# EasyEDA Pro project PRO_project.eprj, board PCB2
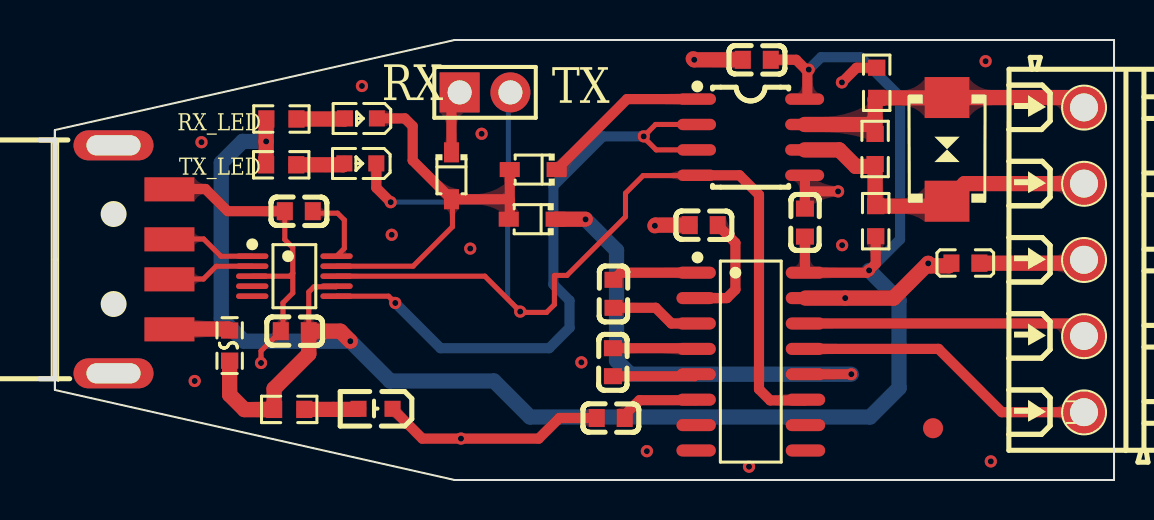
[diagram p15: board, top side]
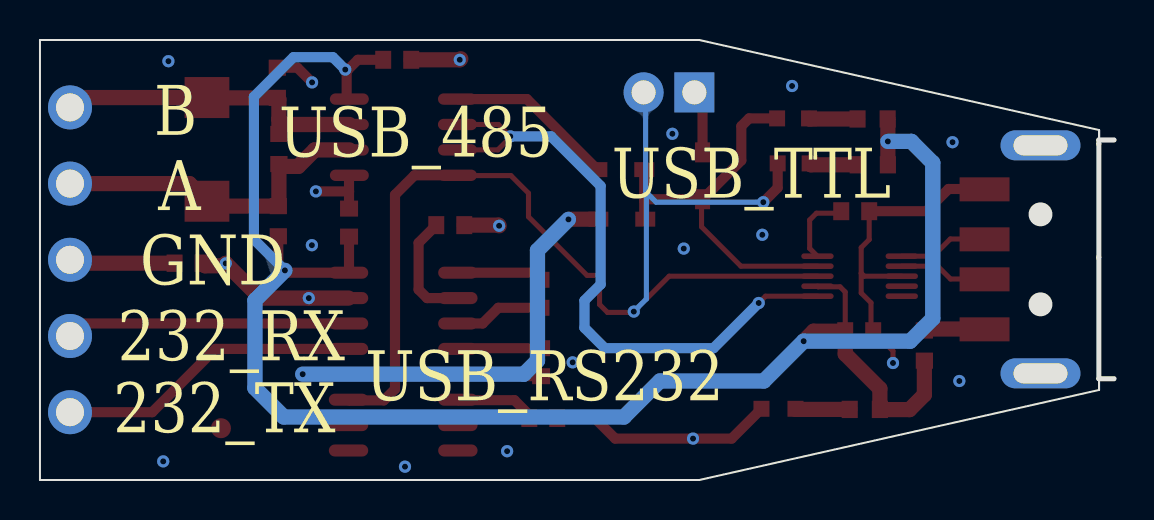
[diagram p16: board, bottom side, seen from below]

Outline 53.75 x 22 mm; copper layers: Top Layer, Bottom Layer. Coordinates in mm from the lower left corner of the outline.
Outline path: 0.75,17.5 0.75,11 0.75,17.5 ; 0.75,17.5 0.75,4.5 ; 0.75,17.5 20.75,22 53.75,22 53.75,0 20.75,0 0.75,4.5 ; 0.75,17.5 0.75,4.5
Stack: Top Layer 0.035mm / Dielectric1 1.51mm FR4 er 4.5 / Bottom Layer 0.035mm

## Design rules (mm)
template: 自定义配置
spacing copperThickness1oz (default): track to track 0.152, other pairs 0.152 to 0.3
spacing copperThickness2oz: track to track 0.203, other pairs 0.152 to 0.3
track width copperThickness1oz (default): min 0.127, default 0.254, max 2.54
track width copperThickness2oz: min 0.203, default 0.254, max 2.54
differential pair differentialPair (default): width min 0.127, default 0.254, max 2.54; gap min 0.152, default 0.152
via viaSize (default): diameter min 0.5, default 0.61, max 10; hole min 0.3, default 0.305, max 6.299

## Placement (name value [footprint] x y rotation side)
C1  100nF  [C0603]  12.95 13.44 180 top
C3  100nF  [C0603]  12.75 7.44 0 top
C4  100nF  [C0603]  38.28 12.87 270 top
C5  100nF  [C0603]  28.7 9.31 90 top
C6  100nF  [C0603]  33.22 12.74 180 top
C7  100nF  [C0603]  35.87 21.01 180 top
C8  100nF  [C0603]  28.67 5.89 90 top
C9  100nF  [C0603]  28.56 3.1 180 top
CN1  WJ124-3.81-5P  [CONN-TH_5P-P3.81_KF124-3.81-5P]  52.25 11.01 90 top
D1  1N5819WS  [SOD-323_L1.8-W1.3-LS2.5-RD]  24.63 13.04 180 top
D2  1N5819WS  [SOD-323_L1.8-W1.3-LS2.5-RD]  24.68 15.52 180 top
D3  1N5819WS  [SOD-323_L1.8-W1.3-LS2.5-RD]  20.59 15.21 270 top
D5  P6SMB6.8CA/TR13  [SMB_L4.6-W3.6-LS5.3-BI]  45.39 16.53 90 top
F1  BSMD0603-050-6V  [F0603]  9.49 6.72 270 top
H1  PZ254V-11-02P  [HDR-TH_2P-P2.54-V-M]  22.27 19.38 0 top
L1  GZ1608D601TF  [L0603]  46.31 10.84 0 top
LED1  KT-0603R  [LED0603-RD]  16.06 18.08 180 top
LED2  KT-0603R  [LED0603-RD]  16.03 15.83 180 top
LED3  KT-0603W  [LED0603-R-RD_WHITE]  16.79 3.56 180 top
MARK1  -  [Mark-Point-1mm]  44.69 2.59 0 top
R1  4.7kΩ  [R0603]  12.08 18.05 180 top
R2  4.7kΩ  [R0603]  12.07 15.76 180 top
R3  4.7kΩ  [R0603]  12.47 3.53 180 top
R4  4.7kΩ  [R0603]  41.87 19.86 90 top
R5  120Ω  [R0603]  41.79 16.55 270 top
R6  4.7kΩ  [R0603]  41.82 12.94 90 top
RS232_1  SP3232EEN-L/TR  [SOIC-16_L9.9-W3.9-P1.27-LS6.0-BL]  35.57 5.92 270 top
U1  CH340X  [MSOP-10_L3.0-W3.0-P0.50-LS5.0-BL]  12.73 10.19 270 top
U2  SP485EEN-L/TR  [SOIC-8_L5.0-W4.0-P1.27-LS6.0-BL]  35.56 17.14 270 top
USB1  U217-041N-4BV81  [USB-A-SMD_U217-041N-4BV81]  5.08 11.03 270 top

## Footprints (pads in the part's own frame, mm; a bottom-side part is the same pattern mirrored in y, then rotated)
C0603
  rect 0.8x0.9 smd: 1(-0.7,0) 2(0.7,0)
CONN-TH_5P-P3.81_KF124-3.81-5P
  round 2.2 hole 1.4: 1(-7.62,0) 2(-3.81,0) 3(0,0) 4(3.81,0) 5(7.62,0)
F0603
  rect 0.806x0.864 smd: 1(-0.753,0) 2(0.753,0)
HDR-TH_2P-P2.54-V-M
  rect 2x2 hole 1.2: 1(-1.27,0)
  round 2 hole 1.2: 2(1.27,0)
L0603
  rect 0.8x0.864 smd: 1(-0.7,0) 2(0.7,0)
LED0603-R-RD_WHITE
  rect 0.8x0.8 smd: 1(0.851,0) 2(-0.851,0)
LED0603-RD
  rect 0.8x0.8 smd: 1(-0.799,0) 2(0.799,0)
Mark-Point-1mm
  round 1 smd: 1(0,0)
MSOP-10_L3.0-W3.0-P0.50-LS5.0-BL
  oval 0.28x1.62 smd: 1(-1,-2.11) 2(-0.5,-2.11) 3(0,-2.11) 4(0.5,-2.11) 5(1,-2.11) 6(1,2.11) 7(0.5,2.11) 8(0,2.11) 9(-0.5,2.11) 10(-1,2.11)
R0603
  rect 0.806x0.864 smd: 1(-0.753,0) 2(0.753,0)
SMB_L4.6-W3.6-LS5.3-BI
  rect 2.047x2.241 smd: 1(-2.591,0) 2(2.591,0)
SOD-323_L1.8-W1.3-LS2.5-RD
  rect 1x0.75 smd: 1(-1.173,0) 2(1.173,0)
SOIC-8_L5.0-W4.0-P1.27-LS6.0-BL
  oval 0.569x1.95 smd: 1(-1.905,-2.705) 2(-0.635,-2.705) 3(0.635,-2.705) 4(1.905,-2.705) 5(1.905,2.705) 6(0.635,2.705) 7(-0.635,2.705) 8(-1.905,2.705)
SOIC-16_L9.9-W3.9-P1.27-LS6.0-BL
  oval 0.602x1.971 smd: 1(-4.445,-2.736) 2(-3.175,-2.736) 3(-1.905,-2.736) 4(-0.635,-2.736) 5(0.635,-2.736) 6(1.905,-2.736) 7(3.175,-2.736) 8(4.445,-2.736) 9(4.445,2.736) 10(3.175,2.736) 11(1.905,2.736) 12(0.635,2.736) 13(-0.635,2.736) 14(-1.905,2.736) 15(-3.175,2.736) 16(-4.445,2.736)
USB-A-SMD_U217-041N-4BV81
  rect 1.2x2.5 smd: 1(3.5,1.4) 2(1,1.4) 3(-1,1.4) 4(-3.5,1.4)
  oval 1.5x4 hole 1x2.7: 5(-5.7,-1.4) 6(5.7,-1.4)

## Nets
As in the schematic, except:
SS: U1.6 U2.2 U2.3

Pads without a net: MARK1 1; RS232_1 7 8 9 10; U1 4 5; USB1 5

## Via types
v1: diameter 0.61, hole 0.305, Top Layer to Bottom Layer, 30 vias

## Routing (per net, layer and track width the routed paths; a pad name or vN(x,y) marks a point on that pad's centre or on a via; arc(x,y) is an arc through that point)
+5V: length 96
  Top Layer w0.254: U1.7 14.81,9.66 13.71,9.66 13.45,9.4 C3.2
  Top Layer w0.508: 38.33,20.52 37.84,21.01 C7.1 ; 38.33,20.52 38.4,20.45 38.4,19.18 U2.8 ; 38.33,20.52 v1(38.47,20.52) ; R6.1 41.82,10.81 v1(41.49,10.48) 41.38,10.37 RS232_1.16 38.28,10.39 C4.2
  Top Layer w0.762: R1.2 11.32,18.04 v1(11.32,16.93) R2.2 ; v1(15.53,6.94) 15.03,7.44 C3.2 13.45,6.3 11.72,4.57 R3.2 11.71,3.52 10.23,3.52 9.49,4.26 F1.2
  Bottom Layer w0.508: v1(41.49,10.48) 43.04,12.03 43.04,19.16 41.06,21.14 39.09,21.14 v1(38.47,20.52)
  Bottom Layer w0.762: v1(41.49,10.48) 42.99,8.98 42.99,4.6 41.54,3.15 24.52,3.15 22.72,4.95 17.52,4.95 v1(15.53,6.94) 10.2,6.94 9.07,8.07 9.07,15.86 10.14,16.93 v1(11.32,16.93)
GND: length 45.9
  Top Layer w0.254: 12.65,10.34 12.65,9.35 12.16,8.86 12.16,7.55 C3.1 11.06,6.45 v1(11.06,5.85) ; 12.65,10.34 12.65,11.62 12.25,12.02 C1.2 ; 12.65,10.34 12.5,10.19 U1.3
  Top Layer w0.508: v1(40.13,19.88) 40.86,20.61 R4.2 ; C1.2 9.39,13.44 8.28,14.55 6.5,14.55 ; 38.28,14.43 38.28,15.22 U2.5 ; 38.28,14.43 v1(39.94,14.43) 39.95,14.44 ; 38.28,14.43 C4.1 ; LED3.2 19.13,2.07 v1(21.07,2.07) 24.96,2.07 25.99,3.1 C9.2
  Top Layer w0.762: C6.2 30.8,12.74 v1(30.77,12.71) ; C7.2 v1(32.74,21.01) 32.69,21.06 ; RS232_1.15 v1(40.3,9.1) 42.72,9.1 v1(44.45,10.83) 44.57,10.71 45.48,10.71 L1.1
  Bottom Layer w0.254: v1(11.06,5.85) 10.96,5.85
  vias: v1(7.74,4.95) v1(8.08,16.89) v1(16.11,19.7) v1(17.6,12.26) v1(21.53,11.57) v1(22.1,17.31) v1(27.09,5.88) v1(30.37,1.44) v1(35.48,0.67) v1(40.14,11.74) v1(47.32,20.94) v1(47.58,0.93)
232_RX: length 14.2
  Top Layer w0.508: 38.31,7.83 51.62,7.83 CN1.2
232_TX: length 15.2
  Top Layer w0.508: RS232_1.13 44.97,6.56 48.13,3.39 CN1.1
232RXD: length 23.5
  Top Layer w0.254: v1(27.3,13.03) 27.29,13.04
  Top Layer w0.508: v1(40.6,5.29) 38.31,5.29 RS232_1.12
  Top Layer w0.762: 27.29,13.04 D1.1
  Bottom Layer w0.762: v1(27.3,13.03) 28.85,11.48 28.85,5.97 29.53,5.29 v1(40.6,5.29)
485RXD: length 8.5
  Top Layer w0.508: U2.1 29.38,19.05 D2.1
ACH: length 16.9
  Top Layer w0.762: U2.6 40,16.51 40.82,15.68 41.67,15.68 R5.2 41.79,13.72 R6.2 45.15,13.69 D5.1 46.27,14.82 CN1.4
BCL: length 16.1
  Top Layer w0.762: R5.1 41.79,18.04 ; 41.79,18.04 41.79,19.03 R4.1 45.38,19.11 D5.2 51.75,19.12 CN1.5 ; 41.79,18.04 41.53,17.78 U2.7
D+: length 4.5
  Top Layer w0.254: U1.1 9.05,11.19 8.19,12.05 6.5,12.05
D-: length 4.4
  Top Layer w0.254: U1.2 8.82,10.69 8.18,10.05 6.5,10.05
SS: length 32
  Top Layer w0.254: U2.3 30.84,16.51 30.21,17.13 v1(30.21,17.18) 30.81,17.78 U2.2 ; U1.6 17.44,9.19 v1(17.78,8.85)
  Bottom Layer w0.508: v1(30.21,17.18) 28.17,17.18 25.69,14.7 25.69,9.78 26.5,8.97 26.5,7.61 25.48,6.59 20.04,6.59 v1(17.78,8.85)
TTL_RXD: length 3.2
  Top Layer w0.508: D3.1 20.59,18.97 H1.1
TXD: length 58.5
  Top Layer w0.254: U2.4 32.84,15.22 30.18,15.22 29.3,14.34 29.3,13.16 26.37,10.23 25.74,10.23 25.74,8.77 25.35,8.38 24.07,8.38 v1(24.03,8.42) 22.26,10.19 U1.8
  Top Layer w0.508: RS232_1.11 38.27,3.98 36.54,3.98 35.98,4.54 35.98,14.26 35.01,15.24 U2.4 ; v1(17.55,13.89) 16.83,14.61 LED2.1
  Bottom Layer w0.254: v1(24.03,8.42) 23.4,9.05 23.4,14.38 ; v1(17.55,13.89) 22.91,13.89 23.4,14.38 ; 23.4,14.38 23.44,14.42 23.44,19.28 H1.2
$1N1630: length 5.7
  Top Layer w0.508: C6.1 34.8,11.86 34.8,9.52 34.38,9.1 RS232_1.2
$1N1631: length 4
  Top Layer w0.508: C9.1 29.26,3.25 30,3.99 32.81,3.99 RS232_1.6
$1N1632: length 4.3
  Top Layer w0.508: RS232_1.1 29.06,10.37 C5.2
$1N1633: length 4.5
  Top Layer w0.508: C5.1 30.81,8.61 31.6,7.83 32.84,7.83
$1N1634: length 4.2
  Top Layer w0.508: C8.2 32.8,6.59 RS232_1.4
$1N1635: length 4.2
  Top Layer w0.508: C8.1 32.74,5.19 RS232_1.5
$1N1654: length 3.7
  Top Layer w0.254: C1.1 13.75,13.34 14.89,13.34 15.23,13 15.23,11.58 U1.10
$1N1658: length 2.7
  Top Layer w0.762: R3.1 15.91,3.53 LED3.1
$1N1663: length 3
  Top Layer w0.762: F1.1 9.42,7.55 6.5,7.55
$1N1670: length 2.4
  Top Layer w0.762: R1.1 15.23,18.05 LED1.2
$1N1672: length 2.4
  Top Layer w0.762: LED2.2 15.16,15.76 R2.1
$1N1681: length 19.9
  Top Layer w0.254: U1.9 18.67,10.69 20.64,12.66 20.64,13.99 D3.2
  Top Layer w0.508: D2.2 23.51,13.98 ; 23.51,13.98 23.51,13.09 D1.2 ; 23.51,13.98 23.46,14.04 D3.2 18.65,15.98 18.65,17.69 18.26,18.08 LED1.1
$1N4570: length 5.3
  Top Layer w0.762: CN1.3 52.08,10.84 L1.2

## Copper pours and planes (outline as drawn; the poured copper is in the pictures)
GND on Top Layer: 6.04,19.58 6.04,2.98 6.44,2.58 16.44,0.64 20.35,-0.08 48.37,-0.08 48.37,22.14 20.6,22.14 18.59,22.06
GND on Bottom Layer: 6.39,19.89 6.39,2.91 9.77,-0.47 46.74,-0.3 50.25,-0.3 50.25,22.79 19.4,22.79 7.98,21.48

Small or netless copper shapes (teardrops, artwork), in the pictures only: 93 on Top Layer, 6 on Bottom Layer

## Text on the board
Bottom Silkscreen Layer: USB_485 | A | B | GND | 232_RX | 232_TX | USB_TTL | USB_RS232
Top Silkscreen Layer: RX_LED | TX_LED | RX | TX
